# Altium schematic sheet Serial.SchDoc: Evaluation Board 3.2
size A3; Organization: Toradex AG; Address1: Altsagenstrasse 5; Address2: Horw; Address3: 6048; Address4: Switzerland; DocumentNumber: 23; Revision: V3.2; SheetNumber: 23; SheetTotal: 23; PageSetup: Record=PageOptions|CenterHorizontal=True|CenterVertical=True|PrintScale=0.73|XCorrection=1.00|YCorrection=1.00|PrintKind=0|BorderSize=5000000|LeftOffset=0|BottomOffset=0|Orientation=2|PaperLength=1000|PaperWidth=1000|Scale=100|PaperSource=7|PrintQuality=-4|MediaType=1|DitherType=10|PaperKind=A4|PrintScaleMode=1
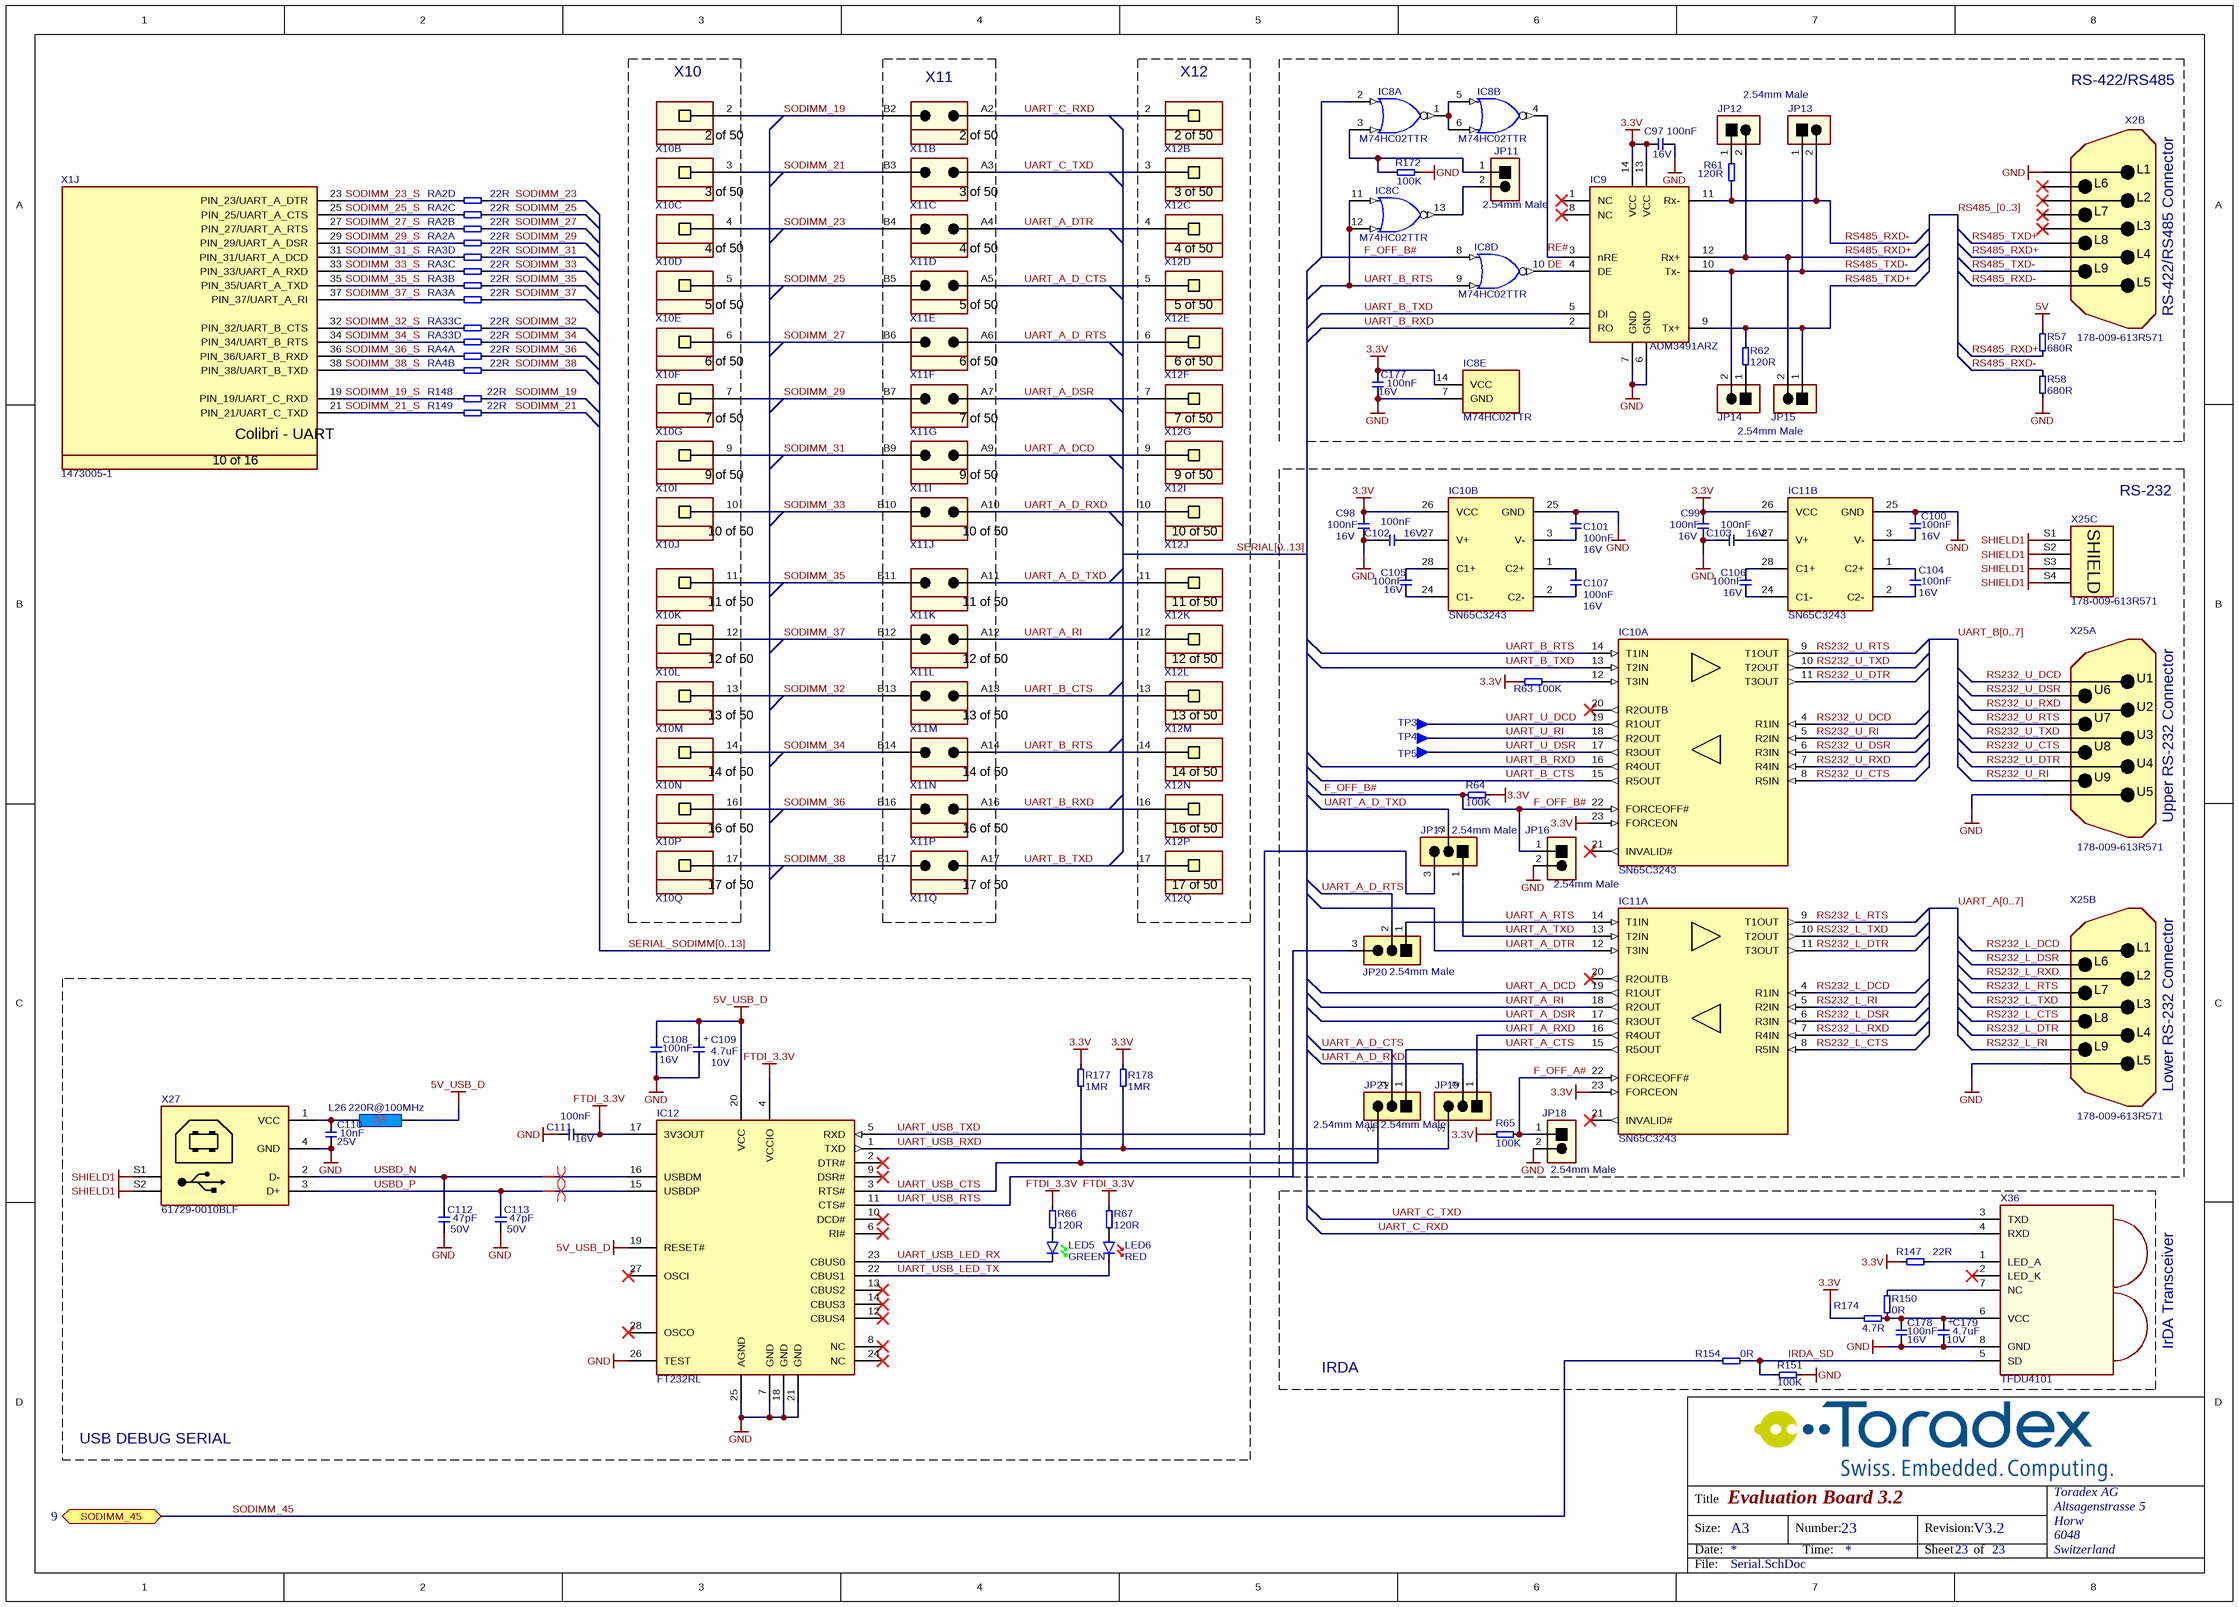
[diagram p0: Serial.SchDoc]

## Parts
C97  Rating: 16V  [T_CAPC0603X33N]  (hidden comment: 100nF)
C98  Rating: 16V  [T_CAPC0603X33N]  (hidden comment: 100nF)
C99  Rating: 16V  [T_CAPC0603X33N]  (hidden comment: 100nF)
C100  Rating: 16V  [T_CAPC0603X33N]  (hidden comment: 100nF)
C101  Rating: 16V  [T_CAPC0603X33N]  (hidden comment: 100nF)
C102  Rating: 16V  [T_CAPC0603X33N]  (hidden comment: 100nF)
C103  Rating: 16V  [T_CAPC0603X33N]  (hidden comment: 100nF)
C104  Rating: 16V  [T_CAPC0603X33N]  (hidden comment: 100nF)
C105  Rating: 16V  [T_CAPC0603X33N]  (hidden comment: 100nF)
C106  Rating: 16V  [T_CAPC0603X33N]  (hidden comment: 100nF)
C107  Rating: 16V  [T_CAPC0603X33N]  (hidden comment: 100nF)
C108  Rating: 16V  [T_CAPC0603X33N]  (hidden comment: 100nF)
C109  Rating: 10V  [T_CAPMP3216X180N]  (hidden comment: 4.7uF)
C110  Rating: 25V  [T_CAPC0603X33N]  (hidden comment: 10nF)
C111  Rating: 16V  [T_CAPC0603X33N]  (hidden comment: 100nF)
C112  Rating: 50V  [T_CAPC0603X33N]  (hidden comment: 47pF)
C113  Rating: 50V  [T_CAPC0603X33N]  (hidden comment: 47pF)
C177  Rating: 16V  [T_CAPC0603X33N]  (hidden comment: 100nF)
C178  Rating: 16V  [T_CAPC0603X33N]  (hidden comment: 100nF)
C179  Rating: 10V  [T_CAPMP3216X180N]  (hidden comment: 4.7uF)
IC8  M74HC02TTR  [T_ST_M74HC02TTR]  (parts A,B,C,D,E of 5)
IC9  ADM3491ARZ  [SOIC127P600X175-14N]
IC10  SN65C3243  [SOP65P780X200-28N]  (parts A,B of 2)
IC11  SN65C3243  [SOP65P780X200-28N]  (parts A,B of 2)
IC12  FT232RL  [T_FTDI_FT232RL]
JP11  TSW-101-07-G-D  [T_Samtec_TSW-101-07-G-D]  (value not drawn)
JP12  TSW-101-07-G-D  [T_Samtec_TSW-101-07-G-D]  (value not drawn)
JP13  TSW-101-07-G-D  [T_Samtec_TSW-101-07-G-D]  (value not drawn)
JP14  TSW-101-07-G-D  [T_Samtec_TSW-101-07-G-D]  (value not drawn)
JP15  TSW-101-07-G-D  [T_Samtec_TSW-101-07-G-D]  (value not drawn)
JP16  TSW-101-07-G-D  [T_Samtec_TSW-101-07-G-D]  (value not drawn)
JP17  826936-3  [T_TYCO_826936-3]  (value not drawn)
JP18  TSW-101-07-G-D  [T_Samtec_TSW-101-07-G-D]  (value not drawn)
JP19  826936-3  [T_TYCO_826936-3]  (value not drawn)
JP20  826936-3  [T_TYCO_826936-3]  (value not drawn)
JP21  826936-3  [T_TYCO_826936-3]  (value not drawn)
L26  220R@100MHz  [INDC1608X95N]
LED5  Color: GREEN  [T_Osram_T670_GREEN]  (hidden comment: LG T670-K1L2-1)
LED6  Color: RED  [T_Osram_T670_RED]  (hidden comment: LS T670-K1L2-1)
R57  680R  [T_RESC0603X30N]
R58  680R  [T_RESC0603X30N]
R61  120R  [T_RESC0603X30N]
R62  120R  [T_RESC0603X30N]
R63  100K  [T_RESC0603X30N]
R64  100K  [T_RESC0603X30N]
R65  100K  [T_RESC0603X30N]
R66  120R  [T_RESC0603X30N]
R67  120R  [T_RESC0603X30N]
R147  22R  [T_RESC0603X30N]
R148  22R  [RESC1005X40N]
R149  22R  [RESC1005X40N]
R150  0R  [T_RESC0603X30N]
R151  100K  [T_RESC0603X30N]
R154  0R  [T_RESC0603X30N]
R172  100K  [T_RESC0603X30N]
R174  4.7R  [RESC1005X40N]
R177  1MR  [T_RESC0603X30N]
R178  1MR  [T_RESC0603X30N]
RA2  22R  [T_Resistor_Array_X4]  (parts A,B,C,D of 4)
RA3  22R  [T_Resistor_Array_X4]  (parts A,B,C,D of 4)
RA4  22R  [T_Resistor_Array_X4]  (parts A,B of 4)
RA33  22R  [T_Resistor_Array_X4]  (parts C,D of 4)
TP3  Testpin  [T_TP-THT]  (value not drawn)
TP4  Testpin  [T_TP-THT]  (value not drawn)
TP5  Testpin  [T_TP-THT]  (value not drawn)
X1  Manufacturer Part No.: 1473005-1  [T_Tyco_1473005-1]  (hidden comment: CON-Tyco-1473005-1-200-0.6mm)  (part J of 16)
X2  178-009-613R571  [T_NorComp_178-YYY-613R691]  (part B of 3)
X10  SSW-110-01-G-S  [T_Samtec_SSW-110-01-G-S]  (value not drawn)  (parts B,C,D,E,F,G,I,J,K,L,M,N,P,Q of 50)
X11  TSW-110-07-G-D  [T_Samtec_TSW-110-07-G-D]  (value not drawn)  (parts B,C,D,E,F,G,I,J,K,L,M,N,P,Q of 50)
X12  SSW-110-01-G-S  [T_Samtec_SSW-110-01-G-S]  (value not drawn)  (parts B,C,D,E,F,G,I,J,K,L,M,N,P,Q of 50)
X25  178-009-613R571  [T_NorComp_178-YYY-613R691]  (parts A,B,C of 3)
X27  61729-0010BLF  [T_FCI_61729-0010BLF]
X36  Manufacturer Part No.: TFDU4101  [T_Vishay_TFDU4101]  (hidden comment: IF-Vishay-TFDU4101)

## Blocks framed on the sheet
X10: X10
X11: X11
X12: X12
USB DEBUG SERIAL: C108-C113 IC12 L26 LED5 LED6 R66 R67 R177 R178 X27
IRDA: C178 C179 R147 R150 R151 R154 R174 X36

## Ports
SODIMM_45 (bidir, see 9)

## Nets
3.3V: C97.1 C98.2 C99.2 C177.2 IC8.14(VCC) IC9.13(VCC) IC9.14(VCC) IC10.23(FORCEON) IC10.26(VCC) IC11.23(FORCEON) IC11.26(VCC) R63.1 R64.2 R65.1 R147.1 R174.1 R177.2 R178.2
5V: R57.2
5V_USB_D: C108.2 C109.1 IC12.19(RESET#) IC12.20(VCC) L26.2
FTDI_3.3V: C111.2 IC12.4(VCCIO) IC12.17(3V3OUT) R66.2 R67.2
GND: C97.2 C98.1 C99.1 C100.2 C101.2 C102.1 C103.1 C108.1 C109.2 C110.1 C111.1 C112.1 C113.1 C177.1 C178.1 C179.2 IC8.7(GND) IC9.6(GND) IC9.7(GND) IC10.25(GND) IC11.25(GND) IC12.7(GND) IC12.18(GND) IC12.21(GND) IC12.25(AGND) IC12.26(TEST) JP16.2 JP18.2 R58.1 R151.1 R172.1 X2.L1(DCD) X25.L5(GND) X25.U5(GND) X27.4(GND) X36.8(GND)
SHIELD1: X25.S1(SHIELD) X25.S2(SHIELD) X25.S3(SHIELD) X25.S4(SHIELD) X27.S1 X27.S2
DE: IC8.10(~{O}) IC9.4(DE)
F_OFF_A#: IC11.22(FORCEOFF#) JP18.1 R65.2
F_OFF_B#: IC8.2(A) IC8.8(A) IC10.22(FORCEOFF#) JP16.1 R64.1
IRDA_SD: R151.2 R154.1 X36.5(SD)
RE#: IC8.4(~{O}) IC9.3(nRE)
RS232_L_CTS: IC11.8(R5IN) X25.L8(CTS)
RS232_L_DCD: IC11.4(R1IN) X25.L1(DCD)
RS232_L_DSR: IC11.6(R3IN) X25.L6(DSR)
RS232_L_DTR: IC11.11(T3OUT) X25.L4(DTR)
RS232_L_RI: IC11.5(R2IN) X25.L9(RI)
RS232_L_RTS: IC11.9(T1OUT) X25.L7(RTS)
RS232_L_RXD: IC11.7(R4IN) X25.L2(RXD)
RS232_L_TXD: IC11.10(T2OUT) X25.L3(TXD)
RS232_U_CTS: IC10.8(R5IN) X25.U8(CTS)
RS232_U_DCD: IC10.4(R1IN) X25.U1(DCD)
RS232_U_DSR: IC10.6(R3IN) X25.U6(DSR)
RS232_U_DTR: IC10.11(T3OUT) X25.U4(DTR)
RS232_U_RI: IC10.5(R2IN) X25.U9(RI)
RS232_U_RTS: IC10.9(T1OUT) X25.U7(RTS)
RS232_U_RXD: IC10.7(R4IN) X25.U2(RXD)
RS232_U_TXD: IC10.10(T2OUT) X25.U3(TXD)
RS485_RXD+: IC9.12(Rx+) JP12.2 JP15.2 R57.1 X2.L4(DTR)
RS485_RXD-: IC9.11(Rx-) JP13.2 R58.2 R61.1 X2.L5(GND)
RS485_TXD+: IC9.9(Tx+) JP15.1 R62.2 X2.L8(CTS)
RS485_TXD-: IC9.10(Tx-) JP13.1 JP14.2 X2.L9(RI)
SODIMM_19: R148.2 X10.2 X11.B2
SODIMM_19_S: R148.1 X1.19(PIN_19/UART_C_RXD)
SODIMM_21: R149.2 X10.3 X11.B3
SODIMM_21_S: R149.1 X1.21(PIN_21/UART_C_TXD)
SODIMM_23: RA2.8 X10.4 X11.B4
SODIMM_23_S: RA2.4 X1.23(PIN_23/UART_A_DTR)
SODIMM_25: RA2.7 X10.5 X11.B5
SODIMM_25_S: RA2.3 X1.25(PIN_25/UART_A_CTS)
SODIMM_27: RA2.6 X10.6 X11.B6
SODIMM_27_S: RA2.2 X1.27(PIN_27/UART_A_RTS)
SODIMM_29: RA2.5 X10.7 X11.B7
SODIMM_29_S: RA2.1 X1.29(PIN_29/UART_A_DSR)
SODIMM_31: RA3.8 X10.9 X11.B9
SODIMM_31_S: RA3.4 X1.31(PIN_31/UART_A_DCD)
SODIMM_32: RA33.7 X10.13 X11.B13
SODIMM_32_S: RA33.3 X1.32(PIN_32/UART_B_CTS)
SODIMM_33: RA3.7 X10.10 X11.B10
SODIMM_33_S: RA3.3 X1.33(PIN_33/UART_A_RXD)
SODIMM_34: RA33.8 X10.14 X11.B14
SODIMM_34_S: RA33.4 X1.34(PIN_34/UART_B_RTS)
SODIMM_35: RA3.6 X10.11 X11.B11
SODIMM_35_S: RA3.2 X1.35(PIN_35/UART_A_TXD)
SODIMM_36: RA4.5 X10.16 X11.B16
SODIMM_36_S: RA4.1 X1.36(PIN_36/UART_B_RXD)
SODIMM_37: RA3.5 X10.12 X11.B12
SODIMM_37_S: RA3.1 X1.37(PIN_37/UART_A_RI)
SODIMM_38: RA4.6 X10.17 X11.B17
SODIMM_38_S: RA4.2 X1.38(PIN_38/UART_B_TXD)
SODIMM_45: R154.2 ; port SODIMM_45
UART_A_CTS: IC11.15(R5OUT) JP21.1
UART_A_D_CTS: JP21.2 X11.A5 X12.5
UART_A_D_RTS: JP20.2 X11.A6 X12.6
UART_A_D_RXD: JP19.2 X11.A10 X12.10
UART_A_D_TXD: JP17.2 X11.A11 X12.11
UART_A_DCD: IC11.19(R1OUT) X11.A9 X12.9
UART_A_DSR: IC11.17(R3OUT) X11.A7 X12.7
UART_A_DTR: IC11.12(T3IN) X11.A4 X12.4
UART_A_RI: IC11.18(R2OUT) X11.A12 X12.12
UART_A_RTS: IC11.14(T1IN) JP20.1
UART_A_RXD: IC11.16(R4OUT) JP19.1
UART_A_TXD: IC11.13(T2IN) JP17.1
UART_B_CTS: IC10.15(R5OUT) X11.A13 X12.13
UART_B_RTS: IC8.9(B) IC8.11(A) IC8.12(B) IC10.14(T1IN) X11.A14 X12.14
UART_B_RXD: IC9.2(RO) IC10.16(R4OUT) X11.A16 X12.16
UART_B_TXD: IC9.5(DI) IC10.13(T2IN) X11.A17 X12.17
UART_C_RXD: X11.A2 X12.2 X36.4(RXD)
UART_C_TXD: X11.A3 X12.3 X36.3(TXD)
UART_U_DCD: IC10.19(R1OUT) TP3.1
UART_U_DSR: IC10.17(R3OUT) TP5.1
UART_U_RI: IC10.18(R2OUT) TP4.1
UART_USB_CTS: IC12.3(RTS#) JP21.3 R177.1
UART_USB_LED_RX: IC12.23(CBUS0) LED5.K
UART_USB_LED_TX: IC12.22(CBUS1) LED6.K
UART_USB_RTS: IC12.11(CTS#) JP20.3
UART_USB_RXD: IC12.1(TXD) JP19.3 R178.1
UART_USB_TXD: IC12.5(RXD) JP17.3
USBD_N: C112.2 IC12.16(USBDM) X27.2(D-)
USBD_P: C113.2 IC12.15(USBDP) X27.3(D+)
NetC100_1: C100.1 IC11.3(V-)
NetC101_1: C101.1 IC10.3(V-)
NetC102_2: C102.2 IC10.27(V+)
NetC103_2: C103.2 IC11.27(V+)
NetC104_1: C104.1 IC11.2(C2-)
NetC104_2: C104.2 IC11.1(C2+)
NetC105_1: C105.1 IC10.24(C1-)
NetC105_2: C105.2 IC10.28(C1+)
NetC106_1: C106.1 IC11.24(C1-)
NetC106_2: C106.2 IC11.28(C1+)
NetC107_1: C107.1 IC10.2(C2-)
NetC107_2: C107.2 IC10.1(C2+)
NetC110_2: C110.2 L26.1 X27.1(VCC)
NetC178_2: C178.2 C179.1 R150.1 R174.2 X36.6(VCC)
NetIC8_1: IC8.1(~{O}) IC8.5(A) IC8.6(B)
NetIC8_3: IC8.3(B) JP11.1 R172.2
NetIC8_13: IC8.13(~{O}) JP11.2
NetIC10_12: IC10.12(T3IN) R63.2
NetJP12_1: JP12.1 R61.2
NetJP14_1: JP14.1 R62.1
NetLED5_A: LED5.A R66.1
NetLED6_A: LED6.A R67.1
NetR147_2: R147.2 X36.1(LED_A)
NetR150_2: R150.2 X36.7(NC)

Not connected (* = marked no-connect by the designer): IC9 1(NC)* 8(NC)*; IC10 20(R2OUTB)* 21(INVALID#)*; IC11 20(R2OUTB)* 21(INVALID#)*; IC12 2(DTR#)* 6(RI#)* 8(NC)* 9(DSR#)* 10(DCD#)* 12(CBUS4)* 13(CBUS2)* 14(CBUS3)* 24(NC)* 27(OSCI)* 28(OSCO)*; X2 L2(RXD)* L3(TXD)* L6(DSR)* L7(RTS)*; X36 2(LED_K)*

## Buses and harness runs
bus RS485_[0..3]
bus SERIAL[0..13]
bus SERIAL_SODIMM[0..13]
bus UART_A[0..7]
bus UART_B[0..7]

## Layout directives
differential pair: USBD_N, USBD_P

## Notes on the sheet
- 2.54mm Male
- RS-422/RS485
- (near JP11) 2.54mm Male
- RS-422/RS485 Connector
- RS-232
- (near JP17) 2.54mm Male
- Upper RS-232 Connector
- (near JP16) 2.54mm Male
- (near JP20) 2.54mm Male
- (near JP21) 2.54mm Male
- Lower RS-232 Connector
- (near JP18) 2.54mm Male
- IrDA Transceiver
- Title
- Size:
- Date:
- A3
- Number:
- Time:
- Revision:
- Sheet
- of
- File:
- (in symbol C-TA-4.7uF-10V-20%-3216) +
- (in symbol CON-Samtec-SSW-110-01-G-S, part B) 2 of 50
- (in symbol CON-Samtec-SSW-110-01-G-S, part C) 3 of 50
- (in symbol CON-Samtec-SSW-110-01-G-S, part D) 4 of 50
- (in symbol CON-Samtec-SSW-110-01-G-S, part E) 5 of 50
- (in symbol CON-Samtec-SSW-110-01-G-S, part F) 6 of 50
- (in symbol CON-Samtec-SSW-110-01-G-S, part G) 7 of 50
- (in symbol CON-Samtec-SSW-110-01-G-S, part I) 9 of 50
- (in symbol CON-Samtec-SSW-110-01-G-S, part J) 10 of 50
- (in symbol CON-Samtec-SSW-110-01-G-S, part K) 11 of 50
- (in symbol CON-Samtec-SSW-110-01-G-S, part L) 12 of 50
- (in symbol CON-Samtec-SSW-110-01-G-S, part M) 13 of 50
- (in symbol CON-Samtec-SSW-110-01-G-S, part N) 14 of 50
- (in symbol CON-Samtec-SSW-110-01-G-S, part P) 16 of 50
- (in symbol CON-Samtec-SSW-110-01-G-S, part Q) 17 of 50
- (in symbol CON-Samtec-TSW-110-07-G-D, part B) 2 of 50
- (in symbol CON-Samtec-TSW-110-07-G-D, part C) 3 of 50
- (in symbol CON-Samtec-TSW-110-07-G-D, part D) 4 of 50
- (in symbol CON-Samtec-TSW-110-07-G-D, part E) 5 of 50
- (in symbol CON-Samtec-TSW-110-07-G-D, part F) 6 of 50
- (in symbol CON-Samtec-TSW-110-07-G-D, part G) 7 of 50
- (in symbol CON-Samtec-TSW-110-07-G-D, part I) 9 of 50
- (in symbol CON-Samtec-TSW-110-07-G-D, part J) 10 of 50
- (in symbol CON-Samtec-TSW-110-07-G-D, part K) 11 of 50
- (in symbol CON-Samtec-TSW-110-07-G-D, part L) 12 of 50
- (in symbol CON-Samtec-TSW-110-07-G-D, part M) 13 of 50
- (in symbol CON-Samtec-TSW-110-07-G-D, part N) 14 of 50
- (in symbol CON-Samtec-TSW-110-07-G-D, part P) 16 of 50
- (in symbol CON-Samtec-TSW-110-07-G-D, part Q) 17 of 50
- (in symbol CON-Tyco-1473005-1-200-0.6mm, part J) Colibri - UART; 10 of 16

## Library data of the parts
C97-C108 C111 C177 C178 = C-X7R-100nF-16V-10%-0603: Capacitor Ceramic X7R 100nF 16V 10% 0603; Tolerance: 10%; Type: X7R; Value: 100nF
C109 C179 = C-TA-4.7uF-10V-20%-3216: Capacitor TA 4.7uF 10V 20% 3216; Tolerance: 20%; Type: TA; Value: 4.7uF
C110 = C-X7R-10nF-25V-10%-0603: Capacitor Ceramic X7R 10nF 25V 10% 0603; Tolerance: 10%; Type: X7R; Value: 10nF
C112 C113 = C-NP0-47pF-50V-10%-0603: Capacitor Ceramic NP0 47pF 50V 10% 0603; Tolerance: 10%; Type: NP0; Value: 47pF
IC8 = IC-ST-M74HC02TTR: Quad 2-Input NOR Gate; Manufacturer Name: ST Microelectronics; Manufacturer part No.: M74HC02TTR
IC9 = IC-AD-ADM3491ARZ: ADM3491ARZ RS-485/RS-422 transceiver; Manufacturer Name: Analog Devices; Manufacturer Part No.: ADM3491ARZ
IC10 IC11 = IC-TI-SN65C3243: RS-232 Serial Transceiver; Manufacturer Name: Texas Instruments; Manufacturer Part No.: SN65C3243
IC12 = IC-FTDI-FT232RL: FT232R USB TO UART; Manufacturer Name: FTDI; Manufacturer Part No.: FT232RL
JP11-JP16 JP18 = CON-Samtec-TSW-101-07-G-D: Header male, 1x2 Pins, 2.54 mm pitch; Manufacturer Name: Samtec; Pitch: 2.54 mm; No. of ways: 1x2; Manufacturer Part no.: TSW-101-07-G-D
JP17 JP20 = CON-Tyco-826936-3-1X3-2.54mm-JP_1: Jumper, 3-Pin; Manufacturer Name: Tyco; No. of ways: 1X3; Pitch: 2.54mm
  JP17: Manufacturer Part No.: 826936-3
JP19 JP21 = CON-Tyco-826936-3-1X3-2.54mm-JP_2: Jumper, 3-Pin; Manufacturer Name: Tyco; No. of ways: 1X3; Pitch: 2.54mm; Manufacturer Part No.: 826936-3
L26 = L-220R@100MHz-2A-25%-0603: 220R@100MHz 2A EMI FILTER; Tolerance: 25%; Rating: 2A; Value: 220R@100MHz
LED5 = LED-Osram-T670-K1L2-1: LED green Osram LG T670-K1L2-1; Manufacturer Part N.: LG T670-K1L2-1; Manufacturer Name: Osram
LED6 = LED-Osram-LS T670-K1L2-1: LED red, Osram LS T670-K1L2-1; Manufacturer Part N.: LS T670-K1L2-1; Manufacturer Name: Osram
R57 R58 = R-680R-63mW-5%-0603: Resistor 680 ohm 63mW 5% 0603; Rating: 63mW; Tolerance: 5%; Value: 680R
R61 R62 R66 R67 = R-120R-63mW-5%-0603: Resistor 120 ohm 63mW 5% 0603; Rating: 63mW; Tolerance: 5%; Value: 120R
R63-R65 R151 R172 = R-100KR-63mW-5%-0603: Resistor 100 Kohm 63mW 5% 0603; Value: 100KR; Rating: 63mW; Tolerance: 5%
R147 = R-22R-63mW-5%-0603: Resistor 22 ohm 63mW 5% 0603; Rating: 63mW; Tolerance: 5%; Value: 22R
R148 R149 = R-22R-63mW-5%-0402: Resistor 22 ohm 63mW 5% 0402; Rating: 63mW; Tolerance: 5%; Value: 22R
R150 R154 = R-0R-63mW-1%-0603: Resistor 0 ohm 63mW 1% 0603; Rating: 63mW; Tolerance: 1%; Value: 0R
R174 = R-4.7R-63mW-5%-0402: Resistor 4.7 ohm 63mW 5% 0402; Rating: 63mW; Tolerance: 5%; Value: 4.7R
R177 R178 = R-1MR-63mW-5%-0603: Resistor 1Mohm 63mW 5% 0603; Rating: 63mW; Tolerance: 5%; Value: 1MR
RA2-RA4 RA33 = RA-22R-63mW-5%-1206-div: Resistor Array 22 R 63mW 5% 1206; Tolerance: 5%; Power Dissipation: 63mW; Value: 22R
TP3-TP5 = Testpin: Testpin TH
X1 = CON-Tyco-1473005-1-200-0.6mm: SODIMM Connector; Manufacturer Name: Tyco; No. of ways: 200
X2 X25 = CON-NorComp-178-009-613R571: RS232 Connector 9 pins male; No. of Ways: 18; Manufacturer Name: NorComp; Manufacturer Part No.: 178-009-613R571
X10 X12 = CON-Samtec-SSW-110-01-G-S: Header 1x50 pin 2.54mm pitch; Manufacturer Name: Samtec; Pitch: 2.54mm; No. of ways: 1x50; Manufacturer Part No.: SSW-110-01-G-S
X11 = CON-Samtec-TSW-110-07-G-D: Header 2x50 pin 2.54mm pitch; Manufacturer Name: Samtec; Pitch: 2.54mm; No. of ways: 2x50; Manufacturer Part No.: TSW-110-07-G-D
X27 = CON-FCI-61729-0010BLF: USB Type B Connector; Manufacturer Name: FCI; No. of ways: 4; Manufacturer Part No.: 61729-0010BLF
X36 = IF-Vishay-TFDU4101: Vishay TFDU4101 Infrared Transceiver; Manufacturer Name: Vishay